# Altium schematic sheet P_Ground.SchDoc
size 594 x 420 mm; Author: ALTIUM GOSTBOM2.0 KEV; SheetNumber: 22; SheetTotal: 48
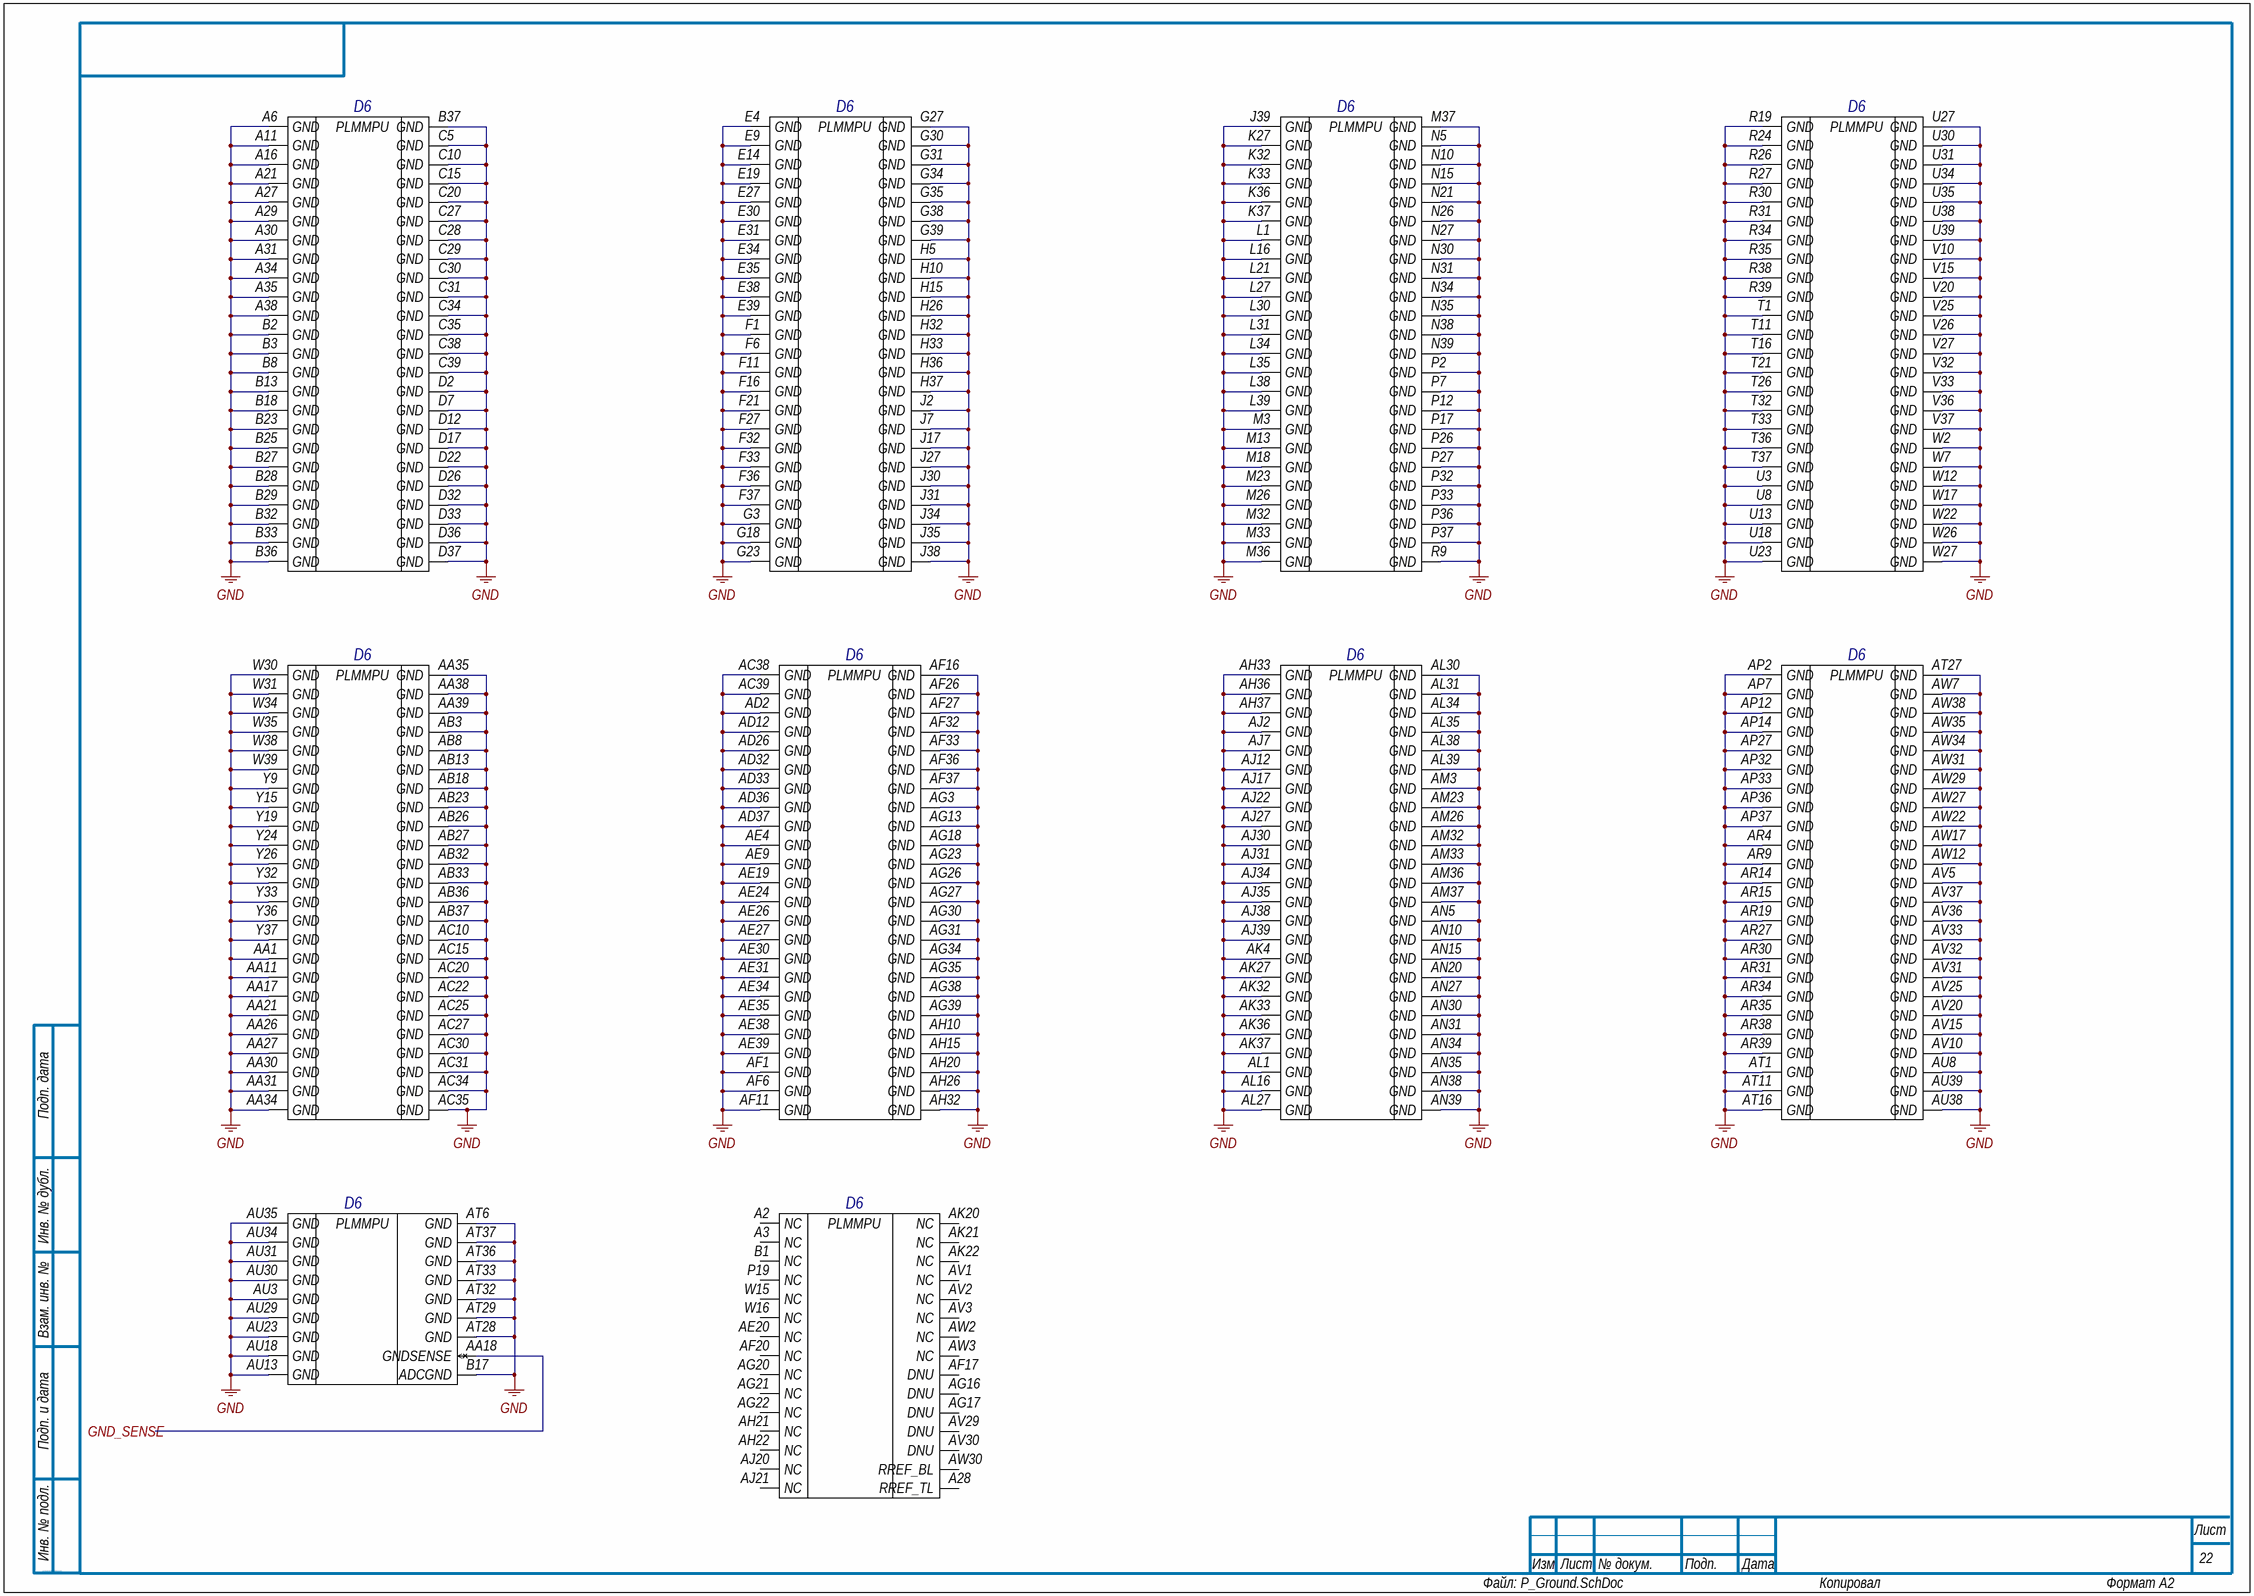
[diagram p0: P_Ground.SchDoc]

## Parts
D6  10AS066N3F40E2SGE2  [ALTR-FBGA1517_A-350]  (value not drawn)  (parts 30,31,32,33,34,35,36,37,38,39 of 39)

## Ports
GND_SENSE

## Nets
GND: D6.A6(GND) D6.A11(GND) D6.A16(GND) D6.A21(GND) D6.A27(GND) D6.A29(GND) D6.A30(GND) D6.A31(GND) D6.A34(GND) D6.A35(GND) D6.A38(GND) D6.AA1(GND) D6.AA11(GND) D6.AA17(GND) D6.AA21(GND) D6.AA26(GND) D6.AA27(GND) D6.AA30(GND) D6.AA31(GND) D6.AA34(GND) D6.AA35(GND) D6.AA38(GND) D6.AA39(GND) D6.AB3(GND) D6.AB8(GND) D6.AB13(GND) D6.AB18(GND) D6.AB23(GND) D6.AB26(GND) D6.AB27(GND) D6.AB32(GND) D6.AB33(GND) D6.AB36(GND) D6.AB37(GND) D6.AC10(GND) D6.AC15(GND) D6.AC20(GND) D6.AC22(GND) D6.AC25(GND) D6.AC27(GND) D6.AC30(GND) D6.AC31(GND) D6.AC34(GND) D6.AC35(GND) D6.AC38(GND) D6.AC39(GND) D6.AD2(GND) D6.AD12(GND) D6.AD26(GND) D6.AD32(GND) D6.AD33(GND) D6.AD36(GND) D6.AD37(GND) D6.AE4(GND) D6.AE9(GND) D6.AE19(GND) D6.AE24(GND) D6.AE26(GND) D6.AE27(GND) D6.AE30(GND) D6.AE31(GND) D6.AE34(GND) D6.AE35(GND) D6.AE38(GND) D6.AE39(GND) D6.AF1(GND) D6.AF6(GND) D6.AF11(GND) D6.AF16(GND) D6.AF26(GND) D6.AF27(GND) D6.AF32(GND) D6.AF33(GND) D6.AF36(GND) D6.AF37(GND) D6.AG3(GND) D6.AG13(GND) D6.AG18(GND) D6.AG23(GND) D6.AG26(GND) D6.AG27(GND) D6.AG30(GND) D6.AG31(GND) D6.AG34(GND) D6.AG35(GND) D6.AG38(GND) D6.AG39(GND) D6.AH10(GND) D6.AH15(GND) D6.AH20(GND) D6.AH26(GND) D6.AH32(GND) D6.AH33(GND) D6.AH36(GND) D6.AH37(GND) D6.AJ2(GND) D6.AJ7(GND) D6.AJ12(GND) D6.AJ17(GND) D6.AJ22(GND) D6.AJ27(GND) D6.AJ30(GND) D6.AJ31(GND) D6.AJ34(GND) D6.AJ35(GND) D6.AJ38(GND) D6.AJ39(GND) D6.AK4(GND) D6.AK27(GND) D6.AK32(GND) D6.AK33(GND) D6.AK36(GND) D6.AK37(GND) D6.AL1(GND) D6.AL16(GND) D6.AL27(GND) D6.AL30(GND) D6.AL31(GND) D6.AL34(GND) D6.AL35(GND) D6.AL38(GND) D6.AL39(GND) D6.AM3(GND) D6.AM23(GND) D6.AM26(GND) D6.AM32(GND) D6.AM33(GND) D6.AM36(GND) D6.AM37(GND) D6.AN5(GND) D6.AN10(GND) D6.AN15(GND) D6.AN20(GND) D6.AN27(GND) D6.AN30(GND) D6.AN31(GND) D6.AN34(GND) D6.AN35(GND) D6.AN38(GND) D6.AN39(GND) D6.AP2(GND) D6.AP7(GND) D6.AP12(GND) D6.AP14(GND) D6.AP27(GND) D6.AP32(GND) D6.AP33(GND) D6.AP36(GND) D6.AP37(GND) D6.AR4(GND) D6.AR9(GND) D6.AR14(GND) D6.AR15(GND) D6.AR19(GND) D6.AR27(GND) D6.AR30(GND) D6.AR31(GND) D6.AR34(GND) D6.AR35(GND) D6.AR38(GND) D6.AR39(GND) D6.AT1(GND) D6.AT6(GND) D6.AT11(GND) D6.AT16(GND) D6.AT27(GND) D6.AT28(GND) D6.AT29(GND) D6.AT32(GND) D6.AT33(GND) D6.AT36(GND) D6.AT37(GND) D6.AU3(GND) D6.AU8(GND) D6.AU13(GND) D6.AU18(GND) D6.AU23(GND) D6.AU29(GND) D6.AU30(GND) D6.AU31(GND) D6.AU34(GND) D6.AU35(GND) D6.AU38(GND) D6.AU39(GND) D6.AV5(GND) D6.AV10(GND) D6.AV15(GND) D6.AV20(GND) D6.AV25(GND) D6.AV31(GND) D6.AV32(GND) D6.AV33(GND) D6.AV36(GND) D6.AV37(GND) D6.AW7(GND) D6.AW12(GND) D6.AW17(GND) D6.AW22(GND) D6.AW27(GND) D6.AW29(GND) D6.AW31(GND) D6.AW34(GND) D6.AW35(GND) D6.AW38(GND) D6.B2(GND) D6.B3(GND) D6.B8(GND) D6.B13(GND) D6.B17(ADCGND) D6.B18(GND) D6.B23(GND) D6.B25(GND) D6.B27(GND) D6.B28(GND) D6.B29(GND) D6.B32(GND) D6.B33(GND) D6.B36(GND) D6.B37(GND) D6.C5(GND) D6.C10(GND) D6.C15(GND) D6.C20(GND) D6.C27(GND) D6.C28(GND) D6.C29(GND) D6.C30(GND) D6.C31(GND) D6.C34(GND) D6.C35(GND) D6.C38(GND) D6.C39(GND) D6.D2(GND) D6.D7(GND) D6.D12(GND) D6.D17(GND) D6.D22(GND) D6.D26(GND) D6.D32(GND) D6.D33(GND) D6.D36(GND) D6.D37(GND) D6.E4(GND) D6.E9(GND) D6.E14(GND) D6.E19(GND) D6.E27(GND) D6.E30(GND) D6.E31(GND) D6.E34(GND) D6.E35(GND) D6.E38(GND) D6.E39(GND) D6.F1(GND) D6.F6(GND) D6.F11(GND) D6.F16(GND) D6.F21(GND) D6.F27(GND) D6.F32(GND) D6.F33(GND) D6.F36(GND) D6.F37(GND) D6.G3(GND) D6.G18(GND) D6.G23(GND) D6.G27(GND) D6.G30(GND) D6.G31(GND) D6.G34(GND) D6.G35(GND) D6.G38(GND) D6.G39(GND) D6.H5(GND) D6.H10(GND) D6.H15(GND) D6.H26(GND) D6.H32(GND) D6.H33(GND) D6.H36(GND) D6.H37(GND) D6.J2(GND) D6.J7(GND) D6.J17(GND) D6.J27(GND) D6.J30(GND) D6.J31(GND) D6.J34(GND) D6.J35(GND) D6.J38(GND) D6.J39(GND) D6.K27(GND) D6.K32(GND) D6.K33(GND) D6.K36(GND) D6.K37(GND) D6.L1(GND) D6.L16(GND) D6.L21(GND) D6.L27(GND) D6.L30(GND) D6.L31(GND) D6.L34(GND) D6.L35(GND) D6.L38(GND) D6.L39(GND) D6.M3(GND) D6.M13(GND) D6.M18(GND) D6.M23(GND) D6.M26(GND) D6.M32(GND) D6.M33(GND) D6.M36(GND) D6.M37(GND) D6.N5(GND) D6.N10(GND) D6.N15(GND) D6.N21(GND) D6.N26(GND) D6.N27(GND) D6.N30(GND) D6.N31(GND) D6.N34(GND) D6.N35(GND) D6.N38(GND) D6.N39(GND) D6.P2(GND) D6.P7(GND) D6.P12(GND) D6.P17(GND) D6.P26(GND) D6.P27(GND) D6.P32(GND) D6.P33(GND) D6.P36(GND) D6.P37(GND) D6.R9(GND) D6.R19(GND) D6.R24(GND) D6.R26(GND) D6.R27(GND) D6.R30(GND) D6.R31(GND) D6.R34(GND) D6.R35(GND) D6.R38(GND) D6.R39(GND) D6.T1(GND) D6.T11(GND) D6.T16(GND) D6.T21(GND) D6.T26(GND) D6.T32(GND) D6.T33(GND) D6.T36(GND) D6.T37(GND) D6.U3(GND) D6.U8(GND) D6.U13(GND) D6.U18(GND) D6.U23(GND) D6.U27(GND) D6.U30(GND) D6.U31(GND) D6.U34(GND) D6.U35(GND) D6.U38(GND) D6.U39(GND) D6.V10(GND) D6.V15(GND) D6.V20(GND) D6.V25(GND) D6.V26(GND) D6.V27(GND) D6.V32(GND) D6.V33(GND) D6.V36(GND) D6.V37(GND) D6.W2(GND) D6.W7(GND) D6.W12(GND) D6.W17(GND) D6.W22(GND) D6.W26(GND) D6.W27(GND) D6.W30(GND) D6.W31(GND) D6.W34(GND) D6.W35(GND) D6.W38(GND) D6.W39(GND) D6.Y9(GND) D6.Y15(GND) D6.Y19(GND) D6.Y24(GND) D6.Y26(GND) D6.Y32(GND) D6.Y33(GND) D6.Y36(GND) D6.Y37(GND)
GND_SENSE: D6.AA18(GNDSENSE) ; port GND_SENSE

Not connected (* = marked no-connect by the designer): D6 A2(NC) A3(NC) A28(RREF_TL) AE20(NC) AF17(DNU) AF20(NC) AG16(DNU) AG17(DNU) AG20(NC) AG21(NC) AG22(NC) AH21(NC) AH22(NC) AJ20(NC) AJ21(NC) AK20(NC) AK21(NC) AK22(NC) AV1(NC) AV2(NC) AV3(NC) AV29(DNU) AV30(DNU) AW2(NC) AW3(NC) AW30(RREF_BL) B1(NC) P19(NC) W15(NC) W16(NC)

## Notes on the sheet
- Подп. дата
- Инв. № дубл.
- Взам. инв. №
- Подп. и дата
- Инв. № подл.
- Изм.
- Лист
- № докум.
- Подп.
- Дата
- ALTIUM GOSTBOM2.0 KEV
- Файл:
- Копировал
- Формат А2
- (in symbol E105, part 30) PLMMPU
- (in symbol E105, part 31) PLMMPU
- (in symbol E105, part 32) PLMMPU
- (in symbol E105, part 33) PLMMPU
- (in symbol E105, part 34) PLMMPU
- (in symbol E105, part 35) PLMMPU
- (in symbol E105, part 36) PLMMPU
- (in symbol E105, part 37) PLMMPU
- (in symbol E105, part 38) PLMMPU
- (in symbol E105, part 39) PLMMPU

## Library data of the parts
D6 = E105: Arria 10 SX Family, 588 I/O Pins, 16 Fractional PLLs, 1517-Pin FBGA, Speed Grade 2, Extended Grade, RoHS; Тип элемента: ПЛИС; Old_des: U1; New_des: D6; UID: E105; Component Kind: Standard; ComponentLink1Description: Manufacturer URL; ComponentLink1URL: https://www.altera.com/; ComponentLink2Description: Datasheet; ComponentLink2URL: https://www.altera.com/content/dam/altera-www/global/en_US/pdfs/literature/hb/arria-10/a10_datasheet.pdf; DatasheetVersion: Rev. 2016-06-24, 06/2016; Mounting Technology: Surface Mount; PackageDescription: 1517-Pin FineLine Ball-Grid Array (FBGA), Body 40 x 40 mm, Pitch 1 mm; PartNumber: 10AS066N3F40E2SGE2; Code_JEDEC: MS-034; ComponentLink3Description: Package Specification; ComponentLink3URL: https://www.altera.com/content/dam/altera-www/global/en_US/pdfs/literature/packaging/04r00461-04.pdf; PackageVersion: Rev. 5.0, 01/2016